# EasyEDA Pro project STM32G303的双FOC电机驱动.eprj, schematic axdr_v1.3, sheets 1 to 2 of 4 (continued)
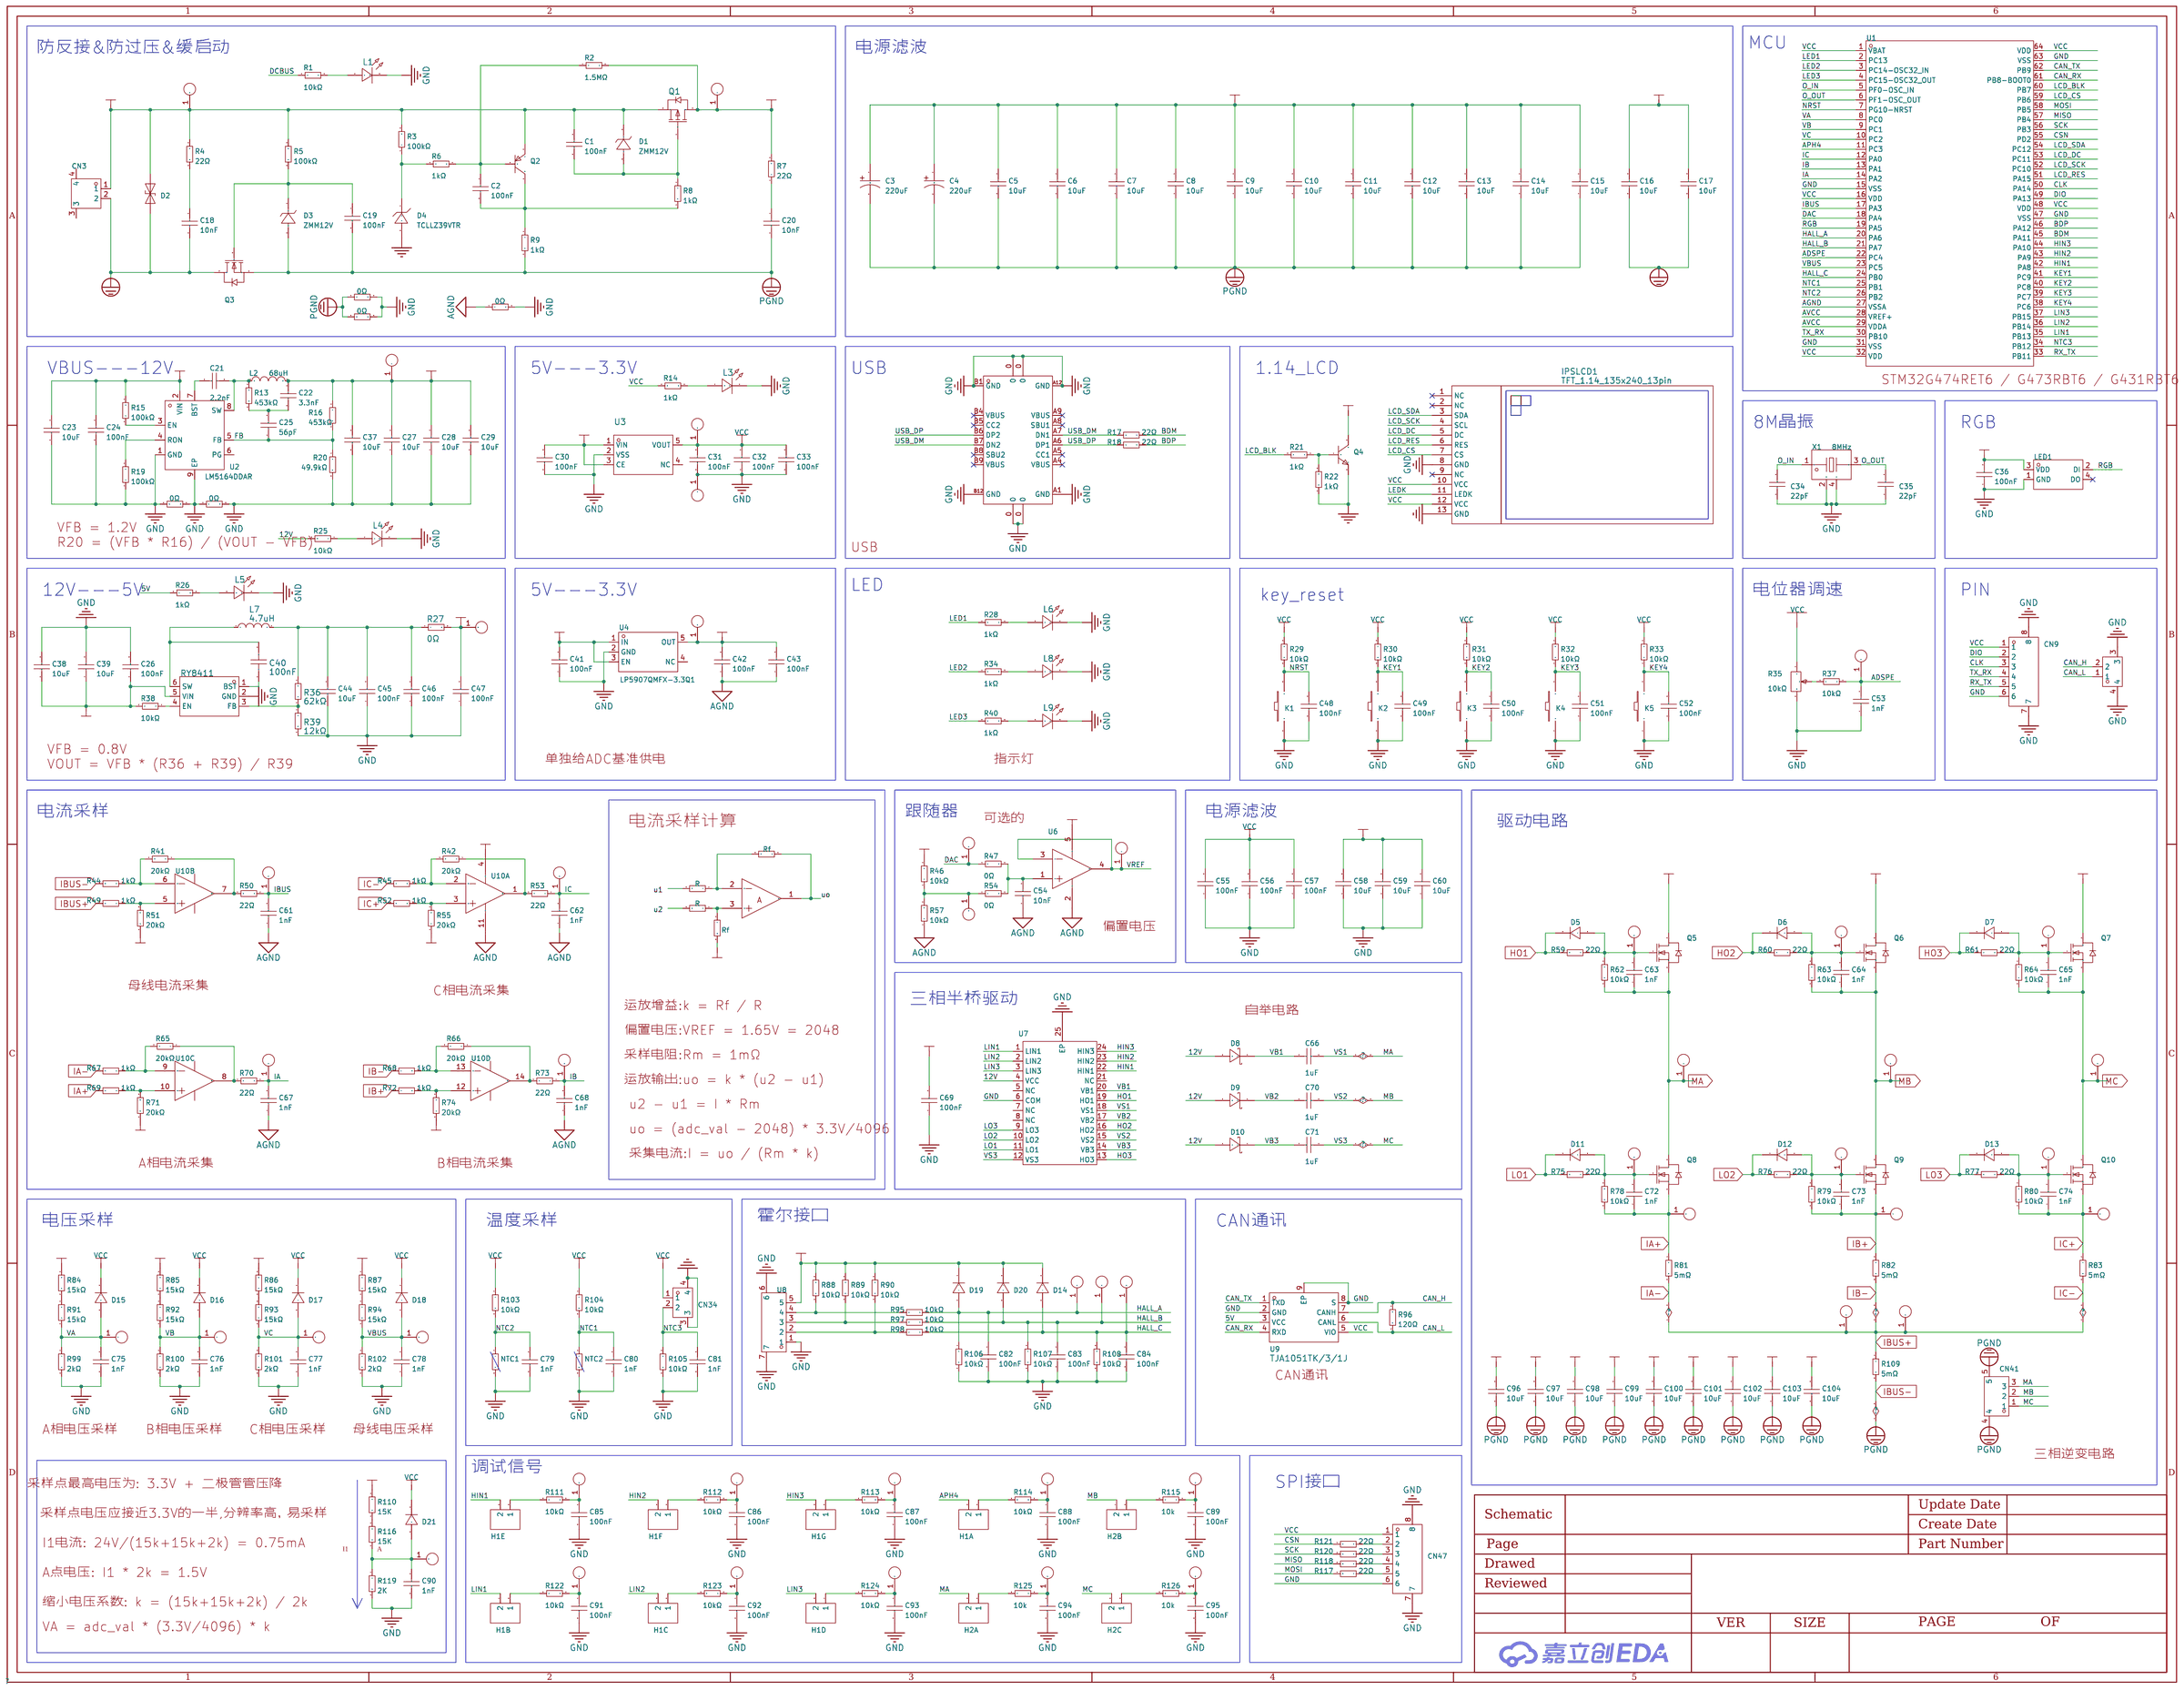
[diagram p0: schematic sheet]
## Library data of the parts (continued)
Q23 = MMBT5401_C2828453: 晶体管类型:PNP;集电极电流(Ic):600mA;集射极击穿电压(Vceo):150V;耗散功率(Pd):300mW;直流电流增益(hFE):100@10mA,5V;; LCSC Part Name: 2L(2L表示丝印) MMBT5401; Supplier Part: C2828453; Manufacturer: CBI(创基); Supplier Footprint: SOT-23; JLCPCB Part Class: 扩展库; Datasheet: https://atta.szlcsc.com/upload/public/pdf/source/20210506/C2828453_2D2D461CC9DAE9618F139B198EA74672.pdf; Supplier: LCSC; type: PNP; Current - Collector(Ic): 600mA; Collector - Emitter Voltage VCEO: 150V; Pd - Power Dissipation: 300mW; DC Current Gain: 100@10mA,5V; Transition frequency(fT): 100MHz; Current - Collector Cutoff: 100nA; Vce Saturation(VCE(sat)): 500mV
Q24 Q25 = MMBT5551_C727129: 晶体管类型:NPN;集电极电流(Ic):600mA;集射极击穿电压(Vceo):160V;功率:300mW;直流电流增益(hFE@Ic,Vce):80@1mA,5V;; LCSC Part Name: G1 H档200-300; Supplier Part: C727129; Manufacturer: TWGMC(台湾迪嘉); Supplier Footprint: SOT-23; JLCPCB Part Class: 扩展库; Datasheet: https://atta.szlcsc.com/upload/public/pdf/source/20200827/C727129_816FD79E18E708B717BACD027B31D989.pdf; Supplier: LCSC; Transistor type: NPN; Collector Current (Ic): 600mA; Collector-Emitter Breakdown Voltage (Vceo): 160V; Power Dissipation (Pd): 300mW; DC Current Gain (hFE@Ic,Vce): 80@1mA,5V; Transition Frequency (fT): 100MHz; Collector Cut-Off Current (Icbo): 50nA; Collector-Emitter Saturation Voltage (VCE(sat)@Ic,Ib): 200mV@50mA,5mA; Operating Temperature: -55℃~+150℃
Q26 = SS8550 Y2(RANGE:200-350): 晶体管类型:PNP;集电极电流(Ic):1.5A;集射极击穿电压(Vceo):25V;功率(Pd):300mW;直流电流增益(hFE@Ic,Vce):200@100mA,1V;; LCSC Part Name: PNP 电流:1.5A 耐压:25V hfe=200~350; Supplier Part: C8542; Manufacturer: CJ(江苏长电/长晶); Supplier Footprint: SOT-23; JLCPCB Part Class: 基础库; Datasheet: https://atta.szlcsc.com/upload/public/pdf/source/20140809/1457707214734.pdf; Supplier: LCSC; Transistor Type: PNP; Collector Current (Ic): 1.5A; Collector-Emitter Breakdown Voltage (Vceo): 25V; Power Dissipation (Pd): 300mW; DC Current Gain (hFE@Ic,Vce): 200@100mA,1V; Transition Frequency (fT): 100MHz; Collector Cut-Off Current (Icbo): 100nA; Collector-Emitter Saturation Voltage (VCE(sat)@Ic,Ib): 500mV@800mA,80mA; Operating Temperature: -55℃~+150℃
R28 R172 = RC0603FR-071KL: 电阻类型:厚膜电阻;阻值:1kΩ;精度:±1%;功率:100mW;; LCSC Part Name: 1kΩ ±1% 100mW; Supplier Part: C22548; Manufacturer: YAGEO(国巨); Supplier Footprint: 0603; JLCPCB Part Class: Extended Part; Datasheet: https://atta.szlcsc.com/upload/public/pdf/source/20180312/7BD3618A8B6324EA6280B0497A051AB7.pdf; Supplier: LCSC; Type: 厚膜电阻; Tolerance: ±1%; Power(Watts): 100mW; Temperature Coefficient: ±100ppm/℃; Overload Voltage (Max): 75V; Operating Temperature Range: -55℃~+155℃; Pin Type: IN; Check: true
R167 = 1k: Supplier Part: C9900012840; JLCPCB Part Class: 扩展库; Supplier: LCSC
R173 R174 = FRC0603F2202TS: 电阻类型:厚膜电阻;阻值:22kΩ;精度:±1%;功率:100mW;工作电压:75V;温度系数:±100ppm/℃;; LCSC Part Name: 22kΩ ±1% 100mW 厚膜电阻; Supplier Part: C2907015; Manufacturer: FOJAN(富捷); Supplier Footprint: 0603; JLCPCB Part Class: 扩展库; Datasheet: https://atta.szlcsc.com/upload/public/pdf/source/20211221/925EC7D7225764EE0046F22065062C87.pdf; Supplier: LCSC; Type: 厚膜电阻; Tolerance: ±1%; Power(Watts): 100mW; Voltage-Supply(Max): 75V; Temperature Coefficient: ±100ppm/℃; Operating Temperature: -55℃~+155℃
R175 R184-R186 R191 R192 = 0603WAF1002T5E: 阻值:10kΩ;精度:±1%;功率:100mW;温度系数:±100ppm/℃;电阻类型:厚膜电阻;; LCSC Part Name: 10kΩ ±1% 100mW 厚膜电阻; Supplier Part: C25804; Manufacturer: UNI-ROYAL(厚声); Supplier Footprint: 0603; JLCPCB Part Class: Basic Part; Datasheet: https://atta.szlcsc.com/upload/public/pdf/source/20200306/C422600_1E6D84923E4A46A82E41ADD87F860B5C.pdf; Supplier: LCSC; Tolerance: ±1%; Power(Watts): 100mW; Overload Voltage (Max): 75V; Temperature Coefficient: ±100ppm/℃; Type: 厚膜电阻; Operating Temperature Range: -55℃~+155℃
R176 R177 = RC0603FR-07100KL: 电阻类型:厚膜电阻;阻值:100kΩ;精度:±1%;功率:100mW;温度系数:±100ppm/℃;; LCSC Part Name: 厚膜电阻 100kΩ ±1% 100mW; Supplier Part: C14675; Manufacturer: YAGEO(国巨); Supplier Footprint: 0603; JLCPCB Part Class: Extended Part; Datasheet: https://atta.szlcsc.com/upload/public/pdf/source/20140324/1457707028752.pdf; Supplier: LCSC; Type: 厚膜电阻; Tolerance: ±1%; Power(Watts): 100mW; Temperature Coefficient: ±100ppm/℃; Overload Voltage (Max): 75V; Operating Temperature Range: -55℃~+155℃
R190 R198-R203 R207-R210 R215-R217 = Res_0603: Supplier Footprint: 0603
R193 = RCA033K3JLF: 阻值:3.3kΩ;精度:±5%;功率:100mW;; LCSC Part Name: 3.3kΩ ±5% 100mW; Supplier Part: C22356670; Manufacturer: HKR(香港电阻); Supplier Footprint: 0603; JLCPCB Part Class: 扩展库; Datasheet: https://atta.szlcsc.com/upload/public/pdf/source/20240312/EB29F8B3E9AD4CE07E65E9956C47F4F5.pdf; Supplier: LCSC; Tolerance: ±5%; Power(Watts): 100mW
R194 R196 R197 = 0603WAF4992T5E: 阻值:49.9kΩ;精度:±1%;功率:100mW;温度系数:±100ppm/℃;电阻类型:厚膜电阻;; LCSC Part Name: 49.9kΩ ±1% 100mW 厚膜电阻; Supplier Part: C23184; Manufacturer: UNI-ROYAL(厚声); Supplier Footprint: 0603; JLCPCB Part Class: Basic Part; Datasheet: https://atta.szlcsc.com/upload/public/pdf/source/20200306/C422600_1E6D84923E4A46A82E41ADD87F860B5C.pdf; Supplier: LCSC; Tolerance: ±1%; Power(Watts): 100mW; Overload Voltage (Max): 75V; Temperature Coefficient: ±100ppm/℃; Type: 厚膜电阻; Operating Temperature Range: -55℃~+155℃
R195 = 0603WAF1200T5E: 阻值:120Ω;精度:±1%;功率:100mW;温度系数:±100ppm/℃;电阻类型:厚膜电阻;; LCSC Part Name: 120Ω ±1% 100mW 厚膜电阻; Supplier Part: C22787; Manufacturer: UNI-ROYAL(厚声); Supplier Footprint: 0603; JLCPCB Part Class: Basic Part; Datasheet: https://atta.szlcsc.com/upload/public/pdf/source/20200306/C422600_1E6D84923E4A46A82E41ADD87F860B5C.pdf; Supplier: LCSC; Tolerance: ±1%; Power(Watts): 100mW; Overload Voltage (Max): 75V; Temperature Coefficient: ±100ppm/℃; Type: 厚膜电阻; Operating Temperature Range: -55℃~+155℃
RL1 RL2 = G5Q-14 DC24: 线圈电压:-;触点形式:-;触点容量(电阻负载):-;最大切换电压:-;最大切换电流:-;; Supplier Part: C397242; Manufacturer: OMRON(欧姆龙); Supplier Footprint: 插件,10x20mm; JLCPCB Part Class: 扩展库; Datasheet: https://atta.szlcsc.com/upload/public/pdf/source/20221128/484119CAADE1EC17AE95C78452500B8B.pdf; Supplier: LCSC
SW1 = TS-1088-AR02016: 电路结构:单刀单掷;按钮形状:圆形按钮;作用力:160gf;安装方式:立贴;开关长度:4mm;开关宽度:3mm;开关高度:2mm;带支架:不带;触点电流:50mA;额定电压(DC):12V;绝缘电阻:100MΩ;机械寿命:10万次;; LCSC Part Name: 4*3*2mm 立贴 轻触开关; Supplier Part: C720477; Manufacturer: XUNPU(讯普); Supplier Footprint: SMD; JLCPCB Part Class: 基础库; Datasheet: https://atta.szlcsc.com/upload/public/pdf/source/20200810/C720475_60D09DD6C54279ADDB2DC25100F1CC11.pdf; Supplier: LCSC; Circuit: 单刀单掷; Actuator Style: 圆形按钮; Operating Force: 160gf; Mounting Style: 立贴; Switch Length: 4mm; Switch Width: 3mm; Switch Height: 2mm; Strike Gundam: 不带; Contact Current: 50mA; Voltage Rating (DC): 12V; Insulation Resistance: 100MΩ; Actuator/Cap Color: 黑色; Pin Style: SMD接片; Mechanical Life: 10万次; Operating Temperature: -30℃~+80℃
tm2 tm3 = X5700WR-2x01-LPSW: 插针结构:2x1P;间距:5.7mm;安装方式:弯插;参考系列:-;总PIN数:2P;排数:2;每排PIN数:1;行距:5.7mm;额定电流:16A;触头材质:黄铜;触头镀层:锡;工作温度范围:-;; LCSC Part Name: 2x1P 间距:5.7mm 弯插; Supplier Part: C2883675; Manufacturer: XKB Connection(中国星坤); Supplier Footprint: 弯插,P=5.7mm; JLCPCB Part Class: 扩展库; Datasheet: https://atta.szlcsc.com/upload/public/pdf/source/20211009/4DD86E7FDC7E8795E640636356594FA2.pdf; Supplier: LCSC; Pins Structure: 2x1P; Pitch: 5.7mm; Mounting Style: 弯插; Number of Pins: 2P; Number of Rows: 2; Number of PINs Per Row: 1; Row Spacing: 5.7mm; Current Rating (Max): 16A; Contact Material: 黄铜; Contact Plating: 锡
TP1 = Test-Point: Test Point 测试点
U31 = BM24C16B/M24C16-RMN6TP/24LC16BT-I/SN: Supplier Part: C9900006483; Supplier Footprint: SOIC-8; JLCPCB Part Class: 扩展库; Supplier: LCSC
U32 = STM32F303VBT6: CPU内核:ARM-M4;CPU最大主频:72MHz;应用领域:-;; LCSC Part Name: 带DSP和FPU的主流混合信号ARM Cortex-M4 MCU，具有128 KB Flash、72 MHz CPU、MPU、CCM、5 MSPS 12位ADC、PGA和比较器; Supplier Part: C1338563; Manufacturer: ST(意法半导体); Supplier Footprint: LQFP-100(14x14); JLCPCB Part Class: 扩展库; Datasheet: https://atta.szlcsc.com/upload/public/pdf/source/20210601/2185005BF889BFC72B7D4098DE21AFA5.pdf; Supplier: LCSC; CPU Core: ARM-M4; CPU Maximum Speed: 72MHz; Program Storage Size: 128KB; Program Memory Type: FLASH; Number of I/O: 87; ADC (Bit): 12bit; DAC (Bit): 12bit; Voltage - Supply: 2V~3.6V
U41 = SP3485EEN-JSM: 类型:收发器;数据速率:15Mbps;; Supplier Part: C29780287; Manufacturer: JSMSEMI(杰盛微); Supplier Footprint: SOP-8; JLCPCB Part Class: 扩展库; Datasheet: https://atta.szlcsc.com/upload/public/pdf/source/20240717/FD7F1635188396F0A70EEC3581A6F698.pdf; Supplier: LCSC; Types: 收发器; Number of Driver: 1; Number of receiver: 1; Supply Voltage: 3.3V~5V; Data Rate: 15Mbps; Operating Temperature: -40℃~+85℃
U42 = HC-PHB2.0-2x3AW: 插针结构:2x3P;间距:2mm;安装方式:弯插;参考系列:PHB;总PIN数:6P;排数:2;每排PIN数:3;行距:2mm;额定电流:3A;触头材质:铜;触头镀层:锡;工作温度:-25℃~+85℃;; LCSC Part Name: 2x3P 间距:2mm 弯插 系列:PHB 米色带扣双排 插件铜; Supplier Part: C19273861; Manufacturer: HC(虹成电子); Supplier Footprint: 弯插,P=2mm; JLCPCB Part Class: 扩展库; Datasheet: https://atta.szlcsc.com/upload/public/pdf/source/20250106/68C9A74C727226BF3738A1B8AD58738C.pdf; Supplier: LCSC; Pins Structure: 2x3P; Pitch: 2mm; Mounting Type: 弯插; Reference Series: PHB; Number of Pins: 6P; Number of Rows: 2; Number of PINs Per Row: 3; Row Spacing: 2mm; Current Rating: 3A; Contact Material: 铜; Contact Plating: 锡; Operating Temperature: -25℃~+85℃; Voltage Rating: 250V; Plastic Material: PA46; Color: 米色; Z-Height of the Board: 8mm; X-Length of Bottom Edge on Board (Spacing Line): 8mm; Y-Width of Bottom Edge on Board: 10.1mm
U50 = PH2.0H2.0L-2*4P2*42mm: Supplier Part: C9900019264; Supplier Footprint: HDR-TH-8P; JLCPCB Part Class: 扩展库; Supplier: LCSC
U52 = IMP809JEUR/T: 复位有效电平:低电平有效;; Supplier Part: C72850; Manufacturer: IMP(日银IMP微电子); Supplier Footprint: SOT-23; JLCPCB Part Class: 扩展库; Datasheet: https://atta.szlcsc.com/upload/public/pdf/source/20160507/1462613616747.pdf; Supplier: LCSC; ChipType: 电压检测器; Reset Active Level: 低电平有效; Threshold Voltage: 4V
U53 U54 = 220uF/35V: Supplier Part: C9900021408; Supplier Footprint: DIP-2/Ф8*13P=3.5mm; JLCPCB Part Class: 扩展库; Supplier: LCSC
X1 = X32258MSB4SI: 频率:8MHz;负载电容:20pF;频率公差:±10ppm;; LCSC Part Name: 8MHz ±10ppm 20pF YSX321SL; Supplier Part: C2682774; Manufacturer: YXC(扬兴晶振); Supplier Footprint: SMD3225-4P; JLCPCB Part Class: Extended Part; Datasheet: https://atta.szlcsc.com/upload/public/pdf/source/20210106/C2682774_0CD4FDA5D9DA3FBEEC23BD607A48E4B0.pdf; Supplier: LCSC; Crystal Type: 贴片无源晶振; Load Capacitance: 20pF; Frequency Tolerance: ±10ppm; Frequency Stability: ±30ppm; Operating Temperature: -40℃~+85℃; Check: true
C61-C65 C67 C68 C72-C74 = 0603B102K500NT: 容值:1nF;精度:±10%;额定电压:50V;材质(温度系数):X7R;; LCSC Part Name: 1nF ±10% 50V; Supplier Part: C44369; Manufacturer: FH(风华); Supplier Footprint: 0603; JLCPCB Part Class: Extended Part; Datasheet: https://atta.szlcsc.com/upload/public/pdf/source/20200305/C486355_26A10D38EF8C2A5C37091D0039909270.pdf; Supplier: LCSC; Tolerance: ±10%; Voltage Rated: 50V; Temperature Coefficient: X7R; Pin Type: IN; Check: true
C66 C70 C71 = C0603_S: Pin Type: IN; Supplier Part: C1604; Check: true
C144-C146 = 0603B103K500NT: 容值:10nF;精度:±10%;额定电压:50V;材质(温度系数):X7R;; LCSC Part Name: 10nF ±10% 50V; Supplier Part: C57112; Manufacturer: FH(风华); Supplier Footprint: 0603; JLCPCB Part Class: Basic Part; Datasheet: https://atta.szlcsc.com/upload/public/pdf/source/20200305/C486355_26A10D38EF8C2A5C37091D0039909270.pdf; Supplier: LCSC; Tolerance: ±10%; Voltage Rated: 50V; Temperature Coefficient: X7R
C151 C152 = CAP_0603: Supplier Footprint: 0603
C155 = 1206B102K202NT: 容值:1nF;精度:±10%;额定电压:2kV;温度系数:X7R;; LCSC Part Name: 1nF ±10% 2kV; Supplier Part: C9196; Manufacturer: FH(风华); Supplier Footprint: 1206; JLCPCB Part Class: 基础库; Datasheet: https://atta.szlcsc.com/upload/public/pdf/source/20200305/C486355_26A10D38EF8C2A5C37091D0039909270.pdf; Supplier: LCSC; Tolerance: ±10%; Voltage Rating: 2kV; Temperature Coefficient: X7R
CN75 = HC-MX3.0-2*3AW: 插针结构:2x3P;间距:3mm;安装方式:弯插;参考系列:Micro-Fit(MX 3.0);总PIN数:6P;排数:2;每排PIN数:3;行距:3mm;额定电流:5A;触头材质:黄铜;触头镀层:锡;工作温度范围:-25℃~+85℃;; LCSC Part Name: 2x3P 间距:3mm 弯插 系列:Micro-Fit(MX 3.0); Supplier Part: C3294384; Manufacturer: HCTL(华灿天禄); Supplier Footprint: 弯插,P=3mm; JLCPCB Part Class: 扩展库; Datasheet: https://atta.szlcsc.com/upload/public/pdf/source/20240325/6515A412CF75DC76B766B405583CF347.pdf; Supplier: LCSC; Pins Structure: 2x3P; Pitch: 3mm; Mounting Style: 弯插; Reference Series: Micro-Fit(MX 3.0); Number of Pins: 6P; Number of Rows: 2; Number of PINs Per Row: 3; Row Spacing: 3mm; Current Rating (Max): 5A; Contact Material: 黄铜; Contact Plating: 锡; Operating Temperature Range: -25℃~+85℃; Rated Voltage (Max): 250V; Plastic Material: PA66; Supplementary Features: 鱼叉脚(塑料); Colour: 黑色
CN78 = HC-XHD-2*2AW: 插针结构:2x2P;间距:2.5mm;安装方式:弯插;参考系列:DF1B;总PIN数:4P;排数:2;每排PIN数:2;行距:2.5mm;额定电流:3A;触头材质:黄铜;触头镀层:锡;工作温度范围:-25℃~+85℃;; LCSC Part Name: 2x2P 间距:2.5mm 弯插 系列:DF1B; Supplier Part: C2845660; Manufacturer: HCTL(华灿天禄); Supplier Footprint: 弯插,P=2.5mm; JLCPCB Part Class: 扩展库; Datasheet: https://atta.szlcsc.com/upload/public/pdf/source/20240524/4C041307FC85BAB65780156B6CC34740.pdf; Supplier: LCSC; Pins Structure: 2x2P; Pitch: 2.5mm; Mounting Style: 弯插; Reference Series: DF1B; Number of Pins: 4P; Number of Rows: 2; Number of PINs Per Row: 2; Row Spacing: 2.5mm; Current Rating (Max): 3A; Contact Material: 黄铜; Contact Plating: 锡; Operating Temperature Range: -25℃~+85℃; Rated Voltage (Max): 250V; Plastic Material: PA; Z-Height of the Board: 8.6mm; X-Length of Bottom Edge on Board (Spacing Line): 7.5mm; Y-Width of Bottom Edge on Board: 12.5mm
D5-D7 D11-D13 = B16WS_C364278: 直流反向耐压(Vr):60V;平均整流电流(Io):1A;正向压降(Vf):700mV@1A;; Supplier Part: C364278; Manufacturer: MDD; Supplier Footprint: SOD-323; JLCPCB Part Class: Extended Part; Datasheet: https://atta.szlcsc.com/upload/public/pdf/source/20190125/C364278_08C9E980565605CB111C36D3361AA1D7.pdf; Supplier: LCSC; Reverse Voltage (Vr): 60V; Average Rectified Current (Io): 1A; Forward Voltage (Vf@If): 700mV@1A; Check: true
D8-D10 = B16WS_C364278: 直流反向耐压(Vr):40V;平均整流电流(Io):1A;正向压降(Vf):650mV@1A;; Supplier Part: C364278; Manufacturer: MDD; Supplier Footprint: SOD-323; JLCPCB Part Class: Extended Part; Datasheet: https://atta.szlcsc.com/upload/public/pdf/source/20190125/C364278_08C9E980565605CB111C36D3361AA1D7.pdf; Supplier: LCSC; Reverse Voltage (Vr): 40V; Average Rectified Current (Io): 1A; Forward Voltage (Vf@If): 650mV@1A; Check: true
H1 = HC-5557-2*2AW: 插针结构:2x2P;间距:4.2mm;安装方式:弯插;参考系列:Mini-Fit(MX 4.2);总PIN数:4P;排数:2;每排PIN数:2;行距:4.2mm;额定电流:9A;触头材质:黄铜;触头镀层:锡;工作温度范围:-25℃~+85℃;; LCSC Part Name: 2x2P 间距:4.2mm 弯插 系列:Mini-Fit(MX 4.2); Supplier Part: C2845787; Manufacturer: HCTL(华灿天禄); Supplier Footprint: 弯插,P=4.2mm; JLCPCB Part Class: 扩展库; Datasheet: https://atta.szlcsc.com/upload/public/pdf/source/20230620/3AA4118B2C2E81189EA8FE45B17A7E9B.pdf; Supplier: LCSC; Pins Structure: 2x2P; Pitch: 4.2mm; Mounting Style: 弯插; Reference Series: Mini-Fit(MX 4.2); Number of Pins: 4P; Number of Rows: 2; Number of PINs Per Row: 2; Row Spacing: 4.2mm; Current Rating (Max): 9A; Contact Material: 黄铜; Contact Plating: 锡; Operating Temperature Range: -25℃~+85℃; Rated Voltage (Max): 600V; Plastic Material: PA66; Flame Retardant Rating: UL94V-0
R41 R42 R51 R55 R65 R66 R71 R74 = RT0603BRD0720KL: 电阻类型:薄膜电阻;阻值:20kΩ;精度:±0.1%;功率:100mW;; LCSC Part Name: 20kΩ ±0.1% 100mW; Supplier Part: C723637; Manufacturer: YAGEO(国巨); Supplier Footprint: 0603; JLCPCB Part Class: Extended Part; Datasheet: https://atta.szlcsc.com/upload/public/pdf/source/20200814/C723637_57E5E8B3C02F5D5BA42E401EB3E82C8B.pdf; Supplier: LCSC; Type: 薄膜电阻; Tolerance: ±0.1%; Power(Watts): 100mW; Temperature Coefficient: ±25ppm/℃; Overload Voltage (Max): 75V; Operating Temperature Range: -55℃~+155℃; Pin Type: IN; Check: true
R44 R45 R49 R52 R67-R69 R72 = RT0603BRD071KL: 电阻类型:薄膜电阻;阻值:1kΩ;精度:±0.1%;功率:100mW;; LCSC Part Name: 1kΩ ±0.1% 100mW; Supplier Part: C110776; Manufacturer: YAGEO(国巨); Supplier Footprint: 0603; JLCPCB Part Class: Extended Part; Datasheet: https://atta.szlcsc.com/upload/public/pdf/source/20170704/1499151282044.pdf; Supplier: LCSC; Type: 薄膜电阻; Tolerance: ±0.1%; Power(Watts): 100mW; Temperature Coefficient: ±25ppm/℃; Overload Voltage (Max): 75V; Operating Temperature Range: -55℃~+155℃; Pin Type: IN; Check: true
R50 R53 R59-R61 R70 R73 R75-R77 = 0603WAF220JT5E: 阻值:22Ω;精度:±1%;功率:100mW;温度系数:±100ppm/℃;电阻类型:厚膜电阻;; LCSC Part Name: 22Ω ±1% 100mW 厚膜电阻; Supplier Part: C23345; Manufacturer: UNI-ROYAL(厚声); Supplier Footprint: 0603; JLCPCB Part Class: Basic Part; Datasheet: https://atta.szlcsc.com/upload/public/pdf/source/20200306/C422600_1E6D84923E4A46A82E41ADD87F860B5C.pdf; Supplier: LCSC; Tolerance: ±1%; Power(Watts): 100mW; Overload Voltage (Max): 75V; Temperature Coefficient: ±100ppm/℃; Type: 厚膜电阻; Operating Temperature Range: -55℃~+155℃; Pin Type: IN; Check: true
R62-R64 R78-R80 = 0603WAF1002T5E: 阻值:10kΩ;精度:±1%;功率:100mW;温度系数:±100ppm/℃;电阻类型:厚膜电阻;; LCSC Part Name: 10kΩ ±1% 100mW 厚膜电阻; Supplier Part: C25804; Manufacturer: UNI-ROYAL(厚声); Supplier Footprint: 0603; JLCPCB Part Class: Basic Part; Datasheet: https://atta.szlcsc.com/upload/public/pdf/source/20200306/C422600_1E6D84923E4A46A82E41ADD87F860B5C.pdf; Supplier: LCSC; Tolerance: ±1%; Power(Watts): 100mW; Overload Voltage (Max): 75V; Temperature Coefficient: ±100ppm/℃; Type: 厚膜电阻; Operating Temperature Range: -55℃~+155℃; Pin Type: IN; Check: true
R81-R83 R109 = LR2512D-3W-5mR-1%: 电阻类型:采样电阻;阻值:5mΩ;精度:±1%;功率:3W;温度系数:25ppm/℃~+50ppm/℃;安装方式:贴片;; LCSC Part Name: 5mΩ ±1% 3W; Supplier Part: C500739; Manufacturer: Milliohm(毫欧); Supplier Footprint: 2512; JLCPCB Part Class: Extended Part; Datasheet: https://atta.szlcsc.com/upload/public/pdf/source/20211008/27BCB003066C6550DC06C87D8395239C.pdf; Supplier: LCSC; Type: 采样电阻; Tolerance: ±1%; Power(Watts): 3W; Temperature Coefficient: 25ppm/℃~+50ppm/℃; Mounting Sytle: 贴片; Pin Type: IN; Check: true
U7 = FD6288Q: Supplier Part: C328453; Manufacturer: Fortior Tech(峰岹); Supplier Footprint: QFN-24-EP(4x4); JLCPCB Part Class: 扩展库; Datasheet: https://atta.szlcsc.com/upload/public/pdf/source/20181108/C328453_785547738DB9FC0123219FC22539EFAD.pdf; Supplier: LCSC; Check: true
U10 = RS624XQ: 超低噪声11nV/√Hz,7MHz,4通道运放; LCSC Part Name: 低噪声运放RS624XQ; Supplier Part: C237013; Manufacturer: RUNIC(润石); Supplier Footprint: TSSOP-14; JLCPCB Part Class: Extended Part; Datasheet: https://atta.szlcsc.com/upload/public/pdf/source/20180629/C237015_68A12BBC706A117D231179E6ED270A16.pdf; Supplier: LCSC; Number of Circuits: 4; Rail to Rail: 轨到轨; Slew Rate(SR): 0.5V/us; Current - Input Bias(Ib): 1pA; Gain Bandwidth Product(GBP): 1.1MHz; Output Current: 55mA; Operating Temperature: -40℃~+125℃; Check: true

## Nets
12V: C69.2 Q23.1(E) R200.1 R201.1 R215.1 R216.1 R217.1 U7.4(VCC) ; also on sheet 3 4
+5V: CN75.1 CN77.1 ; also on sheet 3 4
AGND: C61.1 C62.1 C67.1 C68.1 C144.1 C145.1 C146.1 U10.11(V-) U32.20(VSSA/VREF-) ; also on sheet 3 4
AVCC: U10.4(V+) U32.21(VREF+) U32.22(VDDA) ; also on sheet 3 4
GND: C5.1 C6.1 C12.1 C13.1 C14.1 C15.1 C34.1 C35.1 C55.1 C56.1 C57.1 C69.1 C150.1 C151.1 C152.1 C155.1 CN75.3 CN75.6 CN77.4 CN78.1 CN81.6 CN87.1 CN91.1 D33.1 D34.1 LED1.1(C) LED1.4(C) Q20.2(S) Q21.2(S) Q22.1(S) Q22.2(S) Q22.3(S) Q24.2(E) Q25.2(E) R44.1 R109.2 R167.2 R192.1 R193.1 R197.1 R198.1 R202.2 RL1.4 RL2.4 SW1.1 U7.6(COM) U7.25(EP) U31.1(A0) U31.2(A1) U31.3(A2) U31.4(GND) U31.7(WCB) U32.49(VSS_2) U32.74(VSS_3) U32.99(VSS_1) U41.5(GND) U42.1 U42.3 U50.7 U52.1(GND) U53.2 U54.2 X1.2(GND) X1.4(GND) ; also on sheet 3 4
PGND: C155.2 H1.2 ; also on sheet 4
VBUS: TP1.1 U32.24(PA1)
VCC: C55.2 C56.2 C57.2 C150.2 CN81.1 CN90.1 Q26.2(E) R173.2 R174.2 R175.2 R190.2 R196.2 R207.2 R208.2 U31.8(VCC) U32.6(VBAT) U32.28(VDD_4) U32.50(VDD_2) U32.75(VDD_3) U32.100(VDD_1) U41.8(VCC) U52.3(VCC) ; also on sheet 3 4
BUZZLE: R191.2 U32.90(PB4)
CLK: CN81.3 U32.76(PA14)
DAC: U32.29(PA4)
DAC2: U32.30(PA5)
DCBUS: C5.2 C6.2 C12.2 C13.2 C14.2 C15.2 CN78.3 D31.1(K) D32.1(K) Q27.5(D) Q27.6(D) Q27.7(D) Q27.8(D) Q29.5(D) Q29.6(D) Q29.7(D) Q29.8(D) Q31.5(D) Q31.6(D) Q31.7(D) Q31.8(D) RL1.1 RL1.3 RL2.1 RL2.3 tm3.2 U42.5 U53.1 U54.1 ; also on sheet 3 4
DIO: CN81.2 U32.72(PA13)
H2_IN1: U32.63(PC6) ; also on sheet 4
H2_IN2: U32.64(PC7) ; also on sheet 4
H2_IN3: U32.65(PC8) ; also on sheet 4
HIN1: U7.22(HIN1) U32.67(PA8)
HIN2: U7.23(HIN2) U32.68(PA9)
HIN3: U7.24(HIN3) U32.69(PA10)
HO1: D5.1(-) R59.2 U7.19(HO1)
HO2: D6.1(-) R60.2 U7.16(HO2)
HO3: D7.1(-) R61.2 U7.13(HO3)
IA: C67.2 R70.1 U32.17(PC2)
IA2: U32.58(PD11) ; also on sheet 4
IA+: C72.1 Q28.1(S) Q28.2(S) Q28.3(S) R69.1 R78.2 R81.1 R184.1
IA-: R45.1 R49.1 R67.1 R68.1 R81.2 R82.2 R83.2 R109.1
IB: C68.2 R73.1 U32.18(PC3)
IB2: U32.59(PD12) ; also on sheet 4
IB+: C73.1 Q30.1(S) Q30.2(S) Q30.3(S) R72.1 R79.2 R82.1 R185.1
IBUS: C61.2 R50.1 U32.19(PF2)
IBUS2: U32.27(PF4) ; also on sheet 4
IC: C62.2 R53.1 U32.15(PC0)
IC2: U32.57(PD10) ; also on sheet 4
IC+: C74.1 Q32.1(S) Q32.2(S) Q32.3(S) R52.1 R80.2 R83.1 R186.1
IN1: C152.2 R209.1 U32.37(PB2)
IN2: C151.2 R210.1 U32.38(PE7)
IN3: U32.39(PE8) ; also on sheet 4
IN4: U32.40(PE9) ; also on sheet 4
L2_IN1: U32.78(PC10) ; also on sheet 4
L2_IN2: U32.79(PC11) ; also on sheet 4
L2_IN3: U32.80(PC12) ; also on sheet 4
LED1: R28.2 U32.8(PC14-OSC32_IN(PC14))
LED2: R172.2 U32.9(PC15-OSC32_OUT(PC15))
LIN1: U7.1(LIN1) U32.32(PA7)
LIN2: U7.2(LIN2) U32.41(PE10)
LIN3: U7.3(LIN3) U32.36(PB1)
LO1: D11.1(-) R75.2 U7.11(LO1)
LO2: D12.1(-) R76.2 U7.10(LO2)
LO3: D13.1(-) R77.2 U7.9(LO3)
M1_CH1: CN84.1 U32.84(PD3)
M1_CH2: CN85.1 U32.85(PD4)
M1_OV_1: C144.2 R184.2 U32.26(PA3)
M1_OV_2: C145.2 R185.2 U32.35(PB0)
M1_OV_3: C146.2 R186.2 U32.48(PB11)
M2_CH1: CN82.1 U32.92(PB6)
M2_CH2: CN83.1 U32.71(PA12)
M2_OV_1: U32.61(PD14) ; also on sheet 4
M2_OV_2: U32.52(PB13) ; also on sheet 4
M2_OV_3: U32.23(PA0) ; also on sheet 4
MA: C63.1 C66.1 H1.1 Q27.1(S) Q27.2(S) Q27.3(S) Q28.5(D) Q28.6(D) Q28.7(D) Q28.8(D) R62.2 U7.18(VS1)
MB: C64.1 C70.1 H1.3 Q29.1(S) Q29.2(S) Q29.3(S) Q30.5(D) Q30.6(D) Q30.7(D) Q30.8(D) R63.2 U7.15(VS2)
MC: C65.1 C71.1 H1.4 Q31.1(S) Q31.2(S) Q31.3(S) Q32.5(D) Q32.6(D) Q32.7(D) Q32.8(D) R64.2 U7.12(VS3)
MT2CK: U32.10(PF9) ; also on sheet 4
MT2CS: U32.51(PB12) ; also on sheet 4
MT2DO: U32.53(PB14) ; also on sheet 4
MTCK: CN75.5 U32.89(PB3)
MTCS: CN75.4 U32.83(PD2)
MTDO: CN75.2 U32.31(PA6)
NRST: U32.14(NRST) U52.2(RESET#)
O_IN: C34.2 U32.12(PF0-OSC_IN(PF0)) X1.1
O_OUT: C35.2 U32.13(PF1-OSC_OUT(PF1)) X1.3
OUT3: R203.2 U32.1(PE2)
RELAY1: R176.2 U32.2(PE3)
RELAY2: R177.2 U32.3(PE4)
RS485-B: CN77.2 D34.2 R195.2 R197.2 U41.7(B) U42.4
RS485_A: CN77.3 D33.2 R195.1 R196.1 U41.6(A) U42.6
RX1: U32.34(PC5) U50.2
RX3: R194.1 U32.46(PE15) U41.4(DI)
RX_TX: CN81.5 U32.77(PA15)
SCL: R173.1 U31.6(SCL) U32.95(PB8)
SDA: R174.1 U31.5(SDA) U32.93(PB7)
TX1: U32.33(PC4) U50.1
TX3: U32.47(PB10) U41.1(RO)
TX_RX: CN81.4 U32.25(PA2)
VB1: C66.2 D8.1 U7.20(VB1)
VB2: C70.2 D9.1 U7.17(VB2)
VB3: C71.2 D10.1 U7.14(VB3)
VREF: R51.1 R55.1 R71.1 R74.1 ; also on sheet 3 4
$1N704042: LED1.2(A) R28.1
$1N1663438: R167.1 U32.94(BOOT0)
$1N1664238: LED1.3(A) R172.1
$1N1664722: CN86.1 U32.4(PE5)
$1N1664879: R175.1 SW1.2 U32.5(PE6)
$1N1666049: D31.2(A) Q20.3(D) RL1.5
$1N1666175: Q20.1(G) R176.1
$1N1666422: D32.2(A) Q21.3(D) RL2.5
$1N1666434: Q21.1(G) R177.1
$1N1666848: Q22.5(D) Q22.6(D) Q22.7(D) Q22.8(D) tm3.1
$1N1667282: CN88.1 U32.86(PD5)
$1N1667288: CN89.1 U32.87(PD6)
$1N1667505: RL2.2 tm2.2
$1N1667520: RL1.2 tm2.1
$1N1669768: Q25.1(B) R191.1 R192.2
$1N1670130: BUZZER1.2(-) Q25.3(C)
$1N1670137: BUZZER1.1(+) R190.1
$1N1670397: Q26.3(C) R193.2 U41.2(RE#) U41.3(DE)
$1N1670491: Q26.1(B) R194.2
$1N1676030: Q22.4(G) R198.2 R199.2
$1N1676080: Q23.3(C) R199.1
$1N1676108: Q23.2(B) R200.2
$1N1676142: Q24.3(C) R201.2
$1N1676222: Q24.1(B) R202.1 R203.1
$2N371: D10.2 R217.2
$2N3876: C63.2 D5.2(+) Q27.4(G) R59.1 R62.1
$2N3878: C72.2 D11.2(+) Q28.4(G) R75.1 R78.1
$2N3881: C64.2 D6.2(+) Q29.4(G) R60.1 R63.1
$2N3883: C73.2 D12.2(+) Q30.4(G) R76.1 R79.1
$2N3886: C65.2 D7.2(+) Q31.4(G) R61.1 R64.1
$2N3888: C74.2 D13.2(+) Q32.4(G) R77.1 R80.1
$2N10628: R42.1 R53.2 U10.1(OUTA)
$2N10630: R52.2 R55.2 U10.3(+INA)
$2N10631: R42.2 R45.2 U10.2(-INA)
$2N10633: R41.1 R50.2 U10.7(OUTB)
$2N10635: R49.2 R51.2 U10.5(+INB)
$2N10636: R41.2 R44.2 U10.6(-INB)
$2N10642: R66.1 R73.2 U10.14(OUTD)
$2N10644: R72.2 R74.2 U10.12(+IND)
$2N10645: R66.2 R68.2 U10.13(-IND)
$2N10649: R65.1 R70.2 U10.8(OUTC)
$2N10651: R69.2 R71.2 U10.10(+INC)
$2N10652: R65.2 R67.2 U10.9(-INC)
$2N26375: CN78.2 R207.1 R209.2
$2N26379: CN78.4 R208.1 R210.2
$2N32704: D8.2 R215.2
$2N32706: D9.2 R216.2

Not connected (* = marked no-connect by the designer): U7 5(NC) 7(NC) 8(NC) 21(NC); U32 7(PC13) 11(PF10) 16(PC1) 42(PE11) 43(PE12) 44(PE13) 45(PE14) 54(PB15) 55(PD8) 56(PD9) 60(PD13) 62(PD15) 66(PC9) 70(PA11) 73(PF6) 81(PD0) 82(PD1) 88(PD7) 91(PB5) 96(PB9) 97(PE0) 98(PE1); U42 2; U50 3 4 5 6 8

## Notes on the sheets
sheet 1
- MCU
- 电源滤波
- V OV
- U OV
- 编码器
- U
- V
- W
- W OV
- 过流输入
- 编码器
- 8M晶振
- 正反电机？
- U
- V
- W
- M1 BEAKOUT
- LED
- 指示灯
- START/STOP BUTTON
- 直流输出？
- STM32F303VBT6
- 电源滤波
- SPI_NOR_FLASH
- SWD DEBUG
- 外接rs385
- 外接433模块
sheet 2
- 驱动电路
- 三相半桥驱动
- 自举电路
- 电流采样
- 母线电流采集
- C相电流采集
- U
- V
- W
- A相电流采集
- B相电流采集
- wvu 电机接口
- 电流采样计算
- 三相逆变电路
- 运放增益:k = Rf / R
- 编码器接口
- 偏置电压:VREF = 1.65V = 2048
- 采样电阻:Rm = 1mΩ
- 运放输出:uo = k * (u2 - u1)
- u2 - u1 = I * Rm
- uo = (adc_val - 2048) * 3.3V/4096
- 采集电流:I = uo / (Rm * k)
- 限位器接口
- 过流保护
